# EAGLE schematic Resistor_Resistor (EAGLE 8.3.0), part 43 of 43
## Nets (continued)
N$199: R37801.2 R37802.2 R37803.2 R37804.2 R37805.2 R37806.2 R37807.2 R37808.2 R37809.2 R37810.2 R37811.2 R37812.2 R37813.2 R37814.2 R37815.2 R37816.2 R37817.2 R37818.2 R37819.2 R37820.2 R37821.2 R37822.2 R37823.2 R37824.2 R37825.2 R37826.2 R37827.2 R37828.2 R37829.2 R37830.2 R37831.2 R37832.2 R37833.2 R37834.2 R37835.2 R37836.2 R37837.2 R37838.2 R37839.2 R37840.2 R37841.2 R37842.2 R37843.2 R37844.2 R37845.2 R37846.2 R37847.2 R37848.2 R37849.2 R37850.2 R37851.2 R37852.2 R37853.2 R37854.2 R37855.2 R37856.2 R37857.2 R37858.2 R37859.2 R37860.2 R37861.2 R37862.2 R37863.2 R37864.2 R37865.2 R37866.2 R37867.2 R37868.2 R37869.2 R37870.2 R37871.2 R37872.2 R37873.2 R37874.2 R37875.2 R37876.2 R37877.2 R37878.2 R37879.2 R37880.2 R37881.2 R37882.2 R37883.2 R37884.2 R37885.2 R37886.2 R37887.2 R37888.2 R37889.2 R37890.2 R37891.2 R37892.2 R37893.2 R37894.2 R37895.2 R37896.2 R37897.2 R37898.2 R37899.2 R37900.2 R37901.2 R37902.2 R37903.2 R37904.2 R37905.2 R37906.2 R37907.2 R37908.2 R37909.2 R37910.2 R37911.2 R37912.2 R37913.2 R37914.2 R37915.2 R37916.2 R37917.2 R37918.2 R37919.2 R37920.2 R37921.2 R37922.2 R37923.2 R37924.2 R37925.2 R37926.2 R37927.2 R37928.2 R37929.2 R37930.2 R37931.2 R37932.2 R37933.2 R37934.2 R37935.2 R37936.2 R37937.2 R37938.2 R37939.2 R37940.2 R37941.2 R37942.2 R37943.2 R37944.2 R37945.2 R37946.2 R37947.2 R37948.2 R37949.2 R37950.2 R37951.2 R37952.2 R37953.2 R37954.2 R37955.2 R37956.2 R37957.2 R37958.2 R37959.2 R37960.2 R37961.2 R37962.2 R37963.2 R37964.2 R37965.2 R37966.2 R37967.2 R37968.2 R37969.2 R37970.2 R37971.2 R37972.2 R37973.2 R37974.2 R37975.2 R37976.2 R37977.2 R37978.2 R37979.2 R37980.2 R37981.2 R37982.2 R37983.2 R37984.2 R37985.2 R37986.2 R37987.2 R37988.2 R37989.2 R37990.2 R37991.2 R37992.2 R37993.2 R37994.2 R37995.2 R37996.2 R37997.2 R37998.2 R37999.2 R38000.2 R38001.1 R38002.1 R38003.1 R38004.1 R38005.1 R38006.1 R38007.1 R38008.1 R38009.1 R38010.1 R38011.1 R38012.1 R38013.1 R38014.1 R38015.1 R38016.1 R38017.1 R38018.1 R38019.1 R38020.1 R38021.1 R38022.1 R38023.1 R38024.1 R38025.1 R38026.1 R38027.1 R38028.1 R38029.1 R38030.1 R38031.1 R38032.1 R38033.1 R38034.1 R38035.1 R38036.1 R38037.1 R38038.1 R38039.1 R38040.1 R38041.1 R38042.1 R38043.1 R38044.1 R38045.1 R38046.1 R38047.1 R38048.1 R38049.1 R38050.1 R38051.1 R38052.1 R38053.1 R38054.1 R38055.1 R38056.1 R38057.1 R38058.1 R38059.1 R38060.1 R38061.1 R38062.1 R38063.1 R38064.1 R38065.1 R38066.1 R38067.1 R38068.1 R38069.1 R38070.1 R38071.1 R38072.1 R38073.1 R38074.1 R38075.1 R38076.1 R38077.1 R38078.1 R38079.1 R38080.1 R38081.1 R38082.1 R38083.1 R38084.1 R38085.1 R38086.1 R38087.1 R38088.1 R38089.1 R38090.1 R38091.1 R38092.1 R38093.1 R38094.1 R38095.1 R38096.1 R38097.1 R38098.1 R38099.1 R38100.1 R38101.1 R38102.1 R38103.1 R38104.1 R38105.1 R38106.1 R38107.1 R38108.1 R38109.1 R38110.1 R38111.1 R38112.1 R38113.1 R38114.1 R38115.1 R38116.1 R38117.1 R38118.1 R38119.1 R38120.1 R38121.1 R38122.1 R38123.1 R38124.1 R38125.1 R38126.1 R38127.1 R38128.1 R38129.1 R38130.1 R38131.1 R38132.1 R38133.1 R38134.1 R38135.1 R38136.1 R38137.1 R38138.1 R38139.1 R38140.1 R38141.1 R38142.1 R38143.1 R38144.1 R38145.1 R38146.1 R38147.1 R38148.1 R38149.1 R38150.1 R38151.1 R38152.1 R38153.1 R38154.1 R38155.1 R38156.1 R38157.1 R38158.1 R38159.1 R38160.1 R38161.1 R38162.1 R38163.1 R38164.1 R38165.1 R38166.1 R38167.1 R38168.1 R38169.1 R38170.1 R38171.1 R38172.1 R38173.1 R38174.1 R38175.1 R38176.1 R38177.1 R38178.1 R38179.1 R38180.1 R38181.1 R38182.1 R38183.1 R38184.1 R38185.1 R38186.1 R38187.1 R38188.1 R38189.1 R38190.1 R38191.1 R38192.1 R38193.1 R38194.1 R38195.1 R38196.1 R38197.1 R38198.1 R38199.1 R38200.1
N$200: R38001.2 R38002.2 R38003.2 R38004.2 R38005.2 R38006.2 R38007.2 R38008.2 R38009.2 R38010.2 R38011.2 R38012.2 R38013.2 R38014.2 R38015.2 R38016.2 R38017.2 R38018.2 R38019.2 R38020.2 R38021.2 R38022.2 R38023.2 R38024.2 R38025.2 R38026.2 R38027.2 R38028.2 R38029.2 R38030.2 R38031.2 R38032.2 R38033.2 R38034.2 R38035.2 R38036.2 R38037.2 R38038.2 R38039.2 R38040.2 R38041.2 R38042.2 R38043.2 R38044.2 R38045.2 R38046.2 R38047.2 R38048.2 R38049.2 R38050.2 R38051.2 R38052.2 R38053.2 R38054.2 R38055.2 R38056.2 R38057.2 R38058.2 R38059.2 R38060.2 R38061.2 R38062.2 R38063.2 R38064.2 R38065.2 R38066.2 R38067.2 R38068.2 R38069.2 R38070.2 R38071.2 R38072.2 R38073.2 R38074.2 R38075.2 R38076.2 R38077.2 R38078.2 R38079.2 R38080.2 R38081.2 R38082.2 R38083.2 R38084.2 R38085.2 R38086.2 R38087.2 R38088.2 R38089.2 R38090.2 R38091.2 R38092.2 R38093.2 R38094.2 R38095.2 R38096.2 R38097.2 R38098.2 R38099.2 R38100.2 R38101.2 R38102.2 R38103.2 R38104.2 R38105.2 R38106.2 R38107.2 R38108.2 R38109.2 R38110.2 R38111.2 R38112.2 R38113.2 R38114.2 R38115.2 R38116.2 R38117.2 R38118.2 R38119.2 R38120.2 R38121.2 R38122.2 R38123.2 R38124.2 R38125.2 R38126.2 R38127.2 R38128.2 R38129.2 R38130.2 R38131.2 R38132.2 R38133.2 R38134.2 R38135.2 R38136.2 R38137.2 R38138.2 R38139.2 R38140.2 R38141.2 R38142.2 R38143.2 R38144.2 R38145.2 R38146.2 R38147.2 R38148.2 R38149.2 R38150.2 R38151.2 R38152.2 R38153.2 R38154.2 R38155.2 R38156.2 R38157.2 R38158.2 R38159.2 R38160.2 R38161.2 R38162.2 R38163.2 R38164.2 R38165.2 R38166.2 R38167.2 R38168.2 R38169.2 R38170.2 R38171.2 R38172.2 R38173.2 R38174.2 R38175.2 R38176.2 R38177.2 R38178.2 R38179.2 R38180.2 R38181.2 R38182.2 R38183.2 R38184.2 R38185.2 R38186.2 R38187.2 R38188.2 R38189.2 R38190.2 R38191.2 R38192.2 R38193.2 R38194.2 R38195.2 R38196.2 R38197.2 R38198.2 R38199.2 R38200.2 R38201.1 R38202.1 R38203.1 R38204.1 R38205.1 R38206.1 R38207.1 R38208.1 R38209.1 R38210.1 R38211.1 R38212.1 R38213.1 R38214.1 R38215.1 R38216.1 R38217.1 R38218.1 R38219.1 R38220.1 R38221.1 R38222.1 R38223.1 R38224.1 R38225.1 R38226.1 R38227.1 R38228.1 R38229.1 R38230.1 R38231.1 R38232.1 R38233.1 R38234.1 R38235.1 R38236.1 R38237.1 R38238.1 R38239.1 R38240.1 R38241.1 R38242.1 R38243.1 R38244.1 R38245.1 R38246.1 R38247.1 R38248.1 R38249.1 R38250.1 R38251.1 R38252.1 R38253.1 R38254.1 R38255.1 R38256.1 R38257.1 R38258.1 R38259.1 R38260.1 R38261.1 R38262.1 R38263.1 R38264.1 R38265.1 R38266.1 R38267.1 R38268.1 R38269.1 R38270.1 R38271.1 R38272.1 R38273.1 R38274.1 R38275.1 R38276.1 R38277.1 R38278.1 R38279.1 R38280.1 R38281.1 R38282.1 R38283.1 R38284.1 R38285.1 R38286.1 R38287.1 R38288.1 R38289.1 R38290.1 R38291.1 R38292.1 R38293.1 R38294.1 R38295.1 R38296.1 R38297.1 R38298.1 R38299.1 R38300.1 R38301.1 R38302.1 R38303.1 R38304.1 R38305.1 R38306.1 R38307.1 R38308.1 R38309.1 R38310.1 R38311.1 R38312.1 R38313.1 R38314.1 R38315.1 R38316.1 R38317.1 R38318.1 R38319.1 R38320.1 R38321.1 R38322.1 R38323.1 R38324.1 R38325.1 R38326.1 R38327.1 R38328.1 R38329.1 R38330.1 R38331.1 R38332.1 R38333.1 R38334.1 R38335.1 R38336.1 R38337.1 R38338.1 R38339.1 R38340.1 R38341.1 R38342.1 R38343.1 R38344.1 R38345.1 R38346.1 R38347.1 R38348.1 R38349.1 R38350.1 R38351.1 R38352.1 R38353.1 R38354.1 R38355.1 R38356.1 R38357.1 R38358.1 R38359.1 R38360.1 R38361.1 R38362.1 R38363.1 R38364.1 R38365.1 R38366.1 R38367.1 R38368.1 R38369.1 R38370.1 R38371.1 R38372.1 R38373.1 R38374.1 R38375.1 R38376.1 R38377.1 R38378.1 R38379.1 R38380.1 R38381.1 R38382.1 R38383.1 R38384.1 R38385.1 R38386.1 R38387.1 R38388.1 R38389.1 R38390.1 R38391.1 R38392.1 R38393.1 R38394.1 R38395.1 R38396.1 R38397.1 R38398.1 R38399.1 R38400.1
N$201: R38201.2 R38202.2 R38203.2 R38204.2 R38205.2 R38206.2 R38207.2 R38208.2 R38209.2 R38210.2 R38211.2 R38212.2 R38213.2 R38214.2 R38215.2 R38216.2 R38217.2 R38218.2 R38219.2 R38220.2 R38221.2 R38222.2 R38223.2 R38224.2 R38225.2 R38226.2 R38227.2 R38228.2 R38229.2 R38230.2 R38231.2 R38232.2 R38233.2 R38234.2 R38235.2 R38236.2 R38237.2 R38238.2 R38239.2 R38240.2 R38241.2 R38242.2 R38243.2 R38244.2 R38245.2 R38246.2 R38247.2 R38248.2 R38249.2 R38250.2 R38251.2 R38252.2 R38253.2 R38254.2 R38255.2 R38256.2 R38257.2 R38258.2 R38259.2 R38260.2 R38261.2 R38262.2 R38263.2 R38264.2 R38265.2 R38266.2 R38267.2 R38268.2 R38269.2 R38270.2 R38271.2 R38272.2 R38273.2 R38274.2 R38275.2 R38276.2 R38277.2 R38278.2 R38279.2 R38280.2 R38281.2 R38282.2 R38283.2 R38284.2 R38285.2 R38286.2 R38287.2 R38288.2 R38289.2 R38290.2 R38291.2 R38292.2 R38293.2 R38294.2 R38295.2 R38296.2 R38297.2 R38298.2 R38299.2 R38300.2 R38301.2 R38302.2 R38303.2 R38304.2 R38305.2 R38306.2 R38307.2 R38308.2 R38309.2 R38310.2 R38311.2 R38312.2 R38313.2 R38314.2 R38315.2 R38316.2 R38317.2 R38318.2 R38319.2 R38320.2 R38321.2 R38322.2 R38323.2 R38324.2 R38325.2 R38326.2 R38327.2 R38328.2 R38329.2 R38330.2 R38331.2 R38332.2 R38333.2 R38334.2 R38335.2 R38336.2 R38337.2 R38338.2 R38339.2 R38340.2 R38341.2 R38342.2 R38343.2 R38344.2 R38345.2 R38346.2 R38347.2 R38348.2 R38349.2 R38350.2 R38351.2 R38352.2 R38353.2 R38354.2 R38355.2 R38356.2 R38357.2 R38358.2 R38359.2 R38360.2 R38361.2 R38362.2 R38363.2 R38364.2 R38365.2 R38366.2 R38367.2 R38368.2 R38369.2 R38370.2 R38371.2 R38372.2 R38373.2 R38374.2 R38375.2 R38376.2 R38377.2 R38378.2 R38379.2 R38380.2 R38381.2 R38382.2 R38383.2 R38384.2 R38385.2 R38386.2 R38387.2 R38388.2 R38389.2 R38390.2 R38391.2 R38392.2 R38393.2 R38394.2 R38395.2 R38396.2 R38397.2 R38398.2 R38399.2 R38400.2 R38401.1 R38402.1 R38403.1 R38404.1 R38405.1 R38406.1 R38407.1 R38408.1 R38409.1 R38410.1 R38411.1 R38412.1 R38413.1 R38414.1 R38415.1 R38416.1 R38417.1 R38418.1 R38419.1 R38420.1 R38421.1 R38422.1 R38423.1 R38424.1 R38425.1 R38426.1 R38427.1 R38428.1 R38429.1 R38430.1 R38431.1 R38432.1 R38433.1 R38434.1 R38435.1 R38436.1 R38437.1 R38438.1 R38439.1 R38440.1 R38441.1 R38442.1 R38443.1 R38444.1 R38445.1 R38446.1 R38447.1 R38448.1 R38449.1 R38450.1 R38451.1 R38452.1 R38453.1 R38454.1 R38455.1 R38456.1 R38457.1 R38458.1 R38459.1 R38460.1 R38461.1 R38462.1 R38463.1 R38464.1 R38465.1 R38466.1 R38467.1 R38468.1 R38469.1 R38470.1 R38471.1 R38472.1 R38473.1 R38474.1 R38475.1 R38476.1 R38477.1 R38478.1 R38479.1 R38480.1 R38481.1 R38482.1 R38483.1 R38484.1 R38485.1 R38486.1 R38487.1 R38488.1 R38489.1 R38490.1 R38491.1 R38492.1 R38493.1 R38494.1 R38495.1 R38496.1 R38497.1 R38498.1 R38499.1 R38500.1 R38501.1 R38502.1 R38503.1 R38504.1 R38505.1 R38506.1 R38507.1 R38508.1 R38509.1 R38510.1 R38511.1 R38512.1 R38513.1 R38514.1 R38515.1 R38516.1 R38517.1 R38518.1 R38519.1 R38520.1 R38521.1 R38522.1 R38523.1 R38524.1 R38525.1 R38526.1 R38527.1 R38528.1 R38529.1 R38530.1 R38531.1 R38532.1 R38533.1 R38534.1 R38535.1 R38536.1 R38537.1 R38538.1 R38539.1 R38540.1 R38541.1 R38542.1 R38543.1 R38544.1 R38545.1 R38546.1 R38547.1 R38548.1 R38549.1 R38550.1 R38551.1 R38552.1 R38553.1 R38554.1 R38555.1 R38556.1 R38557.1 R38558.1 R38559.1 R38560.1 R38561.1 R38562.1 R38563.1 R38564.1 R38565.1 R38566.1 R38567.1 R38568.1 R38569.1 R38570.1 R38571.1 R38572.1 R38573.1 R38574.1 R38575.1 R38576.1 R38577.1 R38578.1 R38579.1 R38580.1 R38581.1 R38582.1 R38583.1 R38584.1 R38585.1 R38586.1 R38587.1 R38588.1 R38589.1 R38590.1 R38591.1 R38592.1 R38593.1 R38594.1 R38595.1 R38596.1 R38597.1 R38598.1 R38599.1 R38600.1
N$202: R38401.2 R38402.2 R38403.2 R38404.2 R38405.2 R38406.2 R38407.2 R38408.2 R38409.2 R38410.2 R38411.2 R38412.2 R38413.2 R38414.2 R38415.2 R38416.2 R38417.2 R38418.2 R38419.2 R38420.2 R38421.2 R38422.2 R38423.2 R38424.2 R38425.2 R38426.2 R38427.2 R38428.2 R38429.2 R38430.2 R38431.2 R38432.2 R38433.2 R38434.2 R38435.2 R38436.2 R38437.2 R38438.2 R38439.2 R38440.2 R38441.2 R38442.2 R38443.2 R38444.2 R38445.2 R38446.2 R38447.2 R38448.2 R38449.2 R38450.2 R38451.2 R38452.2 R38453.2 R38454.2 R38455.2 R38456.2 R38457.2 R38458.2 R38459.2 R38460.2 R38461.2 R38462.2 R38463.2 R38464.2 R38465.2 R38466.2 R38467.2 R38468.2 R38469.2 R38470.2 R38471.2 R38472.2 R38473.2 R38474.2 R38475.2 R38476.2 R38477.2 R38478.2 R38479.2 R38480.2 R38481.2 R38482.2 R38483.2 R38484.2 R38485.2 R38486.2 R38487.2 R38488.2 R38489.2 R38490.2 R38491.2 R38492.2 R38493.2 R38494.2 R38495.2 R38496.2 R38497.2 R38498.2 R38499.2 R38500.2 R38501.2 R38502.2 R38503.2 R38504.2 R38505.2 R38506.2 R38507.2 R38508.2 R38509.2 R38510.2 R38511.2 R38512.2 R38513.2 R38514.2 R38515.2 R38516.2 R38517.2 R38518.2 R38519.2 R38520.2 R38521.2 R38522.2 R38523.2 R38524.2 R38525.2 R38526.2 R38527.2 R38528.2 R38529.2 R38530.2 R38531.2 R38532.2 R38533.2 R38534.2 R38535.2 R38536.2 R38537.2 R38538.2 R38539.2 R38540.2 R38541.2 R38542.2 R38543.2 R38544.2 R38545.2 R38546.2 R38547.2 R38548.2 R38549.2 R38550.2 R38551.2 R38552.2 R38553.2 R38554.2 R38555.2 R38556.2 R38557.2 R38558.2 R38559.2 R38560.2 R38561.2 R38562.2 R38563.2 R38564.2 R38565.2 R38566.2 R38567.2 R38568.2 R38569.2 R38570.2 R38571.2 R38572.2 R38573.2 R38574.2 R38575.2 R38576.2 R38577.2 R38578.2 R38579.2 R38580.2 R38581.2 R38582.2 R38583.2 R38584.2 R38585.2 R38586.2 R38587.2 R38588.2 R38589.2 R38590.2 R38591.2 R38592.2 R38593.2 R38594.2 R38595.2 R38596.2 R38597.2 R38598.2 R38599.2 R38600.2 R38601.1 R38602.1 R38603.1 R38604.1 R38605.1 R38606.1 R38607.1 R38608.1 R38609.1 R38610.1 R38611.1 R38612.1 R38613.1 R38614.1 R38615.1 R38616.1 R38617.1 R38618.1 R38619.1 R38620.1 R38621.1 R38622.1 R38623.1 R38624.1 R38625.1 R38626.1 R38627.1 R38628.1 R38629.1 R38630.1 R38631.1 R38632.1 R38633.1 R38634.1 R38635.1 R38636.1 R38637.1 R38638.1 R38639.1 R38640.1 R38641.1 R38642.1 R38643.1 R38644.1 R38645.1 R38646.1 R38647.1 R38648.1 R38649.1 R38650.1 R38651.1 R38652.1 R38653.1 R38654.1 R38655.1 R38656.1 R38657.1 R38658.1 R38659.1 R38660.1 R38661.1 R38662.1 R38663.1 R38664.1 R38665.1 R38666.1 R38667.1 R38668.1 R38669.1 R38670.1 R38671.1 R38672.1 R38673.1 R38674.1 R38675.1 R38676.1 R38677.1 R38678.1 R38679.1 R38680.1 R38681.1 R38682.1 R38683.1 R38684.1 R38685.1 R38686.1 R38687.1 R38688.1 R38689.1 R38690.1 R38691.1 R38692.1 R38693.1 R38694.1 R38695.1 R38696.1 R38697.1 R38698.1 R38699.1 R38700.1 R38701.1 R38702.1 R38703.1 R38704.1 R38705.1 R38706.1 R38707.1 R38708.1 R38709.1 R38710.1 R38711.1 R38712.1 R38713.1 R38714.1 R38715.1 R38716.1 R38717.1 R38718.1 R38719.1 R38720.1 R38721.1 R38722.1 R38723.1 R38724.1 R38725.1 R38726.1 R38727.1 R38728.1 R38729.1 R38730.1 R38731.1 R38732.1 R38733.1 R38734.1 R38735.1 R38736.1 R38737.1 R38738.1 R38739.1 R38740.1 R38741.1 R38742.1 R38743.1 R38744.1 R38745.1 R38746.1 R38747.1 R38748.1 R38749.1 R38750.1 R38751.1 R38752.1 R38753.1 R38754.1 R38755.1 R38756.1 R38757.1 R38758.1 R38759.1 R38760.1 R38761.1 R38762.1 R38763.1 R38764.1 R38765.1 R38766.1 R38767.1 R38768.1 R38769.1 R38770.1 R38771.1 R38772.1 R38773.1 R38774.1 R38775.1 R38776.1 R38777.1 R38778.1 R38779.1 R38780.1 R38781.1 R38782.1 R38783.1 R38784.1 R38785.1 R38786.1 R38787.1 R38788.1 R38789.1 R38790.1 R38791.1 R38792.1 R38793.1 R38794.1 R38795.1 R38796.1 R38797.1 R38798.1 R38799.1 R38800.1
N$203: R38601.2 R38602.2 R38603.2 R38604.2 R38605.2 R38606.2 R38607.2 R38608.2 R38609.2 R38610.2 R38611.2 R38612.2 R38613.2 R38614.2 R38615.2 R38616.2 R38617.2 R38618.2 R38619.2 R38620.2 R38621.2 R38622.2 R38623.2 R38624.2 R38625.2 R38626.2 R38627.2 R38628.2 R38629.2 R38630.2 R38631.2 R38632.2 R38633.2 R38634.2 R38635.2 R38636.2 R38637.2 R38638.2 R38639.2 R38640.2 R38641.2 R38642.2 R38643.2 R38644.2 R38645.2 R38646.2 R38647.2 R38648.2 R38649.2 R38650.2 R38651.2 R38652.2 R38653.2 R38654.2 R38655.2 R38656.2 R38657.2 R38658.2 R38659.2 R38660.2 R38661.2 R38662.2 R38663.2 R38664.2 R38665.2 R38666.2 R38667.2 R38668.2 R38669.2 R38670.2 R38671.2 R38672.2 R38673.2 R38674.2 R38675.2 R38676.2 R38677.2 R38678.2 R38679.2 R38680.2 R38681.2 R38682.2 R38683.2 R38684.2 R38685.2 R38686.2 R38687.2 R38688.2 R38689.2 R38690.2 R38691.2 R38692.2 R38693.2 R38694.2 R38695.2 R38696.2 R38697.2 R38698.2 R38699.2 R38700.2 R38701.2 R38702.2 R38703.2 R38704.2 R38705.2 R38706.2 R38707.2 R38708.2 R38709.2 R38710.2 R38711.2 R38712.2 R38713.2 R38714.2 R38715.2 R38716.2 R38717.2 R38718.2 R38719.2 R38720.2 R38721.2 R38722.2 R38723.2 R38724.2 R38725.2 R38726.2 R38727.2 R38728.2 R38729.2 R38730.2 R38731.2 R38732.2 R38733.2 R38734.2 R38735.2 R38736.2 R38737.2 R38738.2 R38739.2 R38740.2 R38741.2 R38742.2 R38743.2 R38744.2 R38745.2 R38746.2 R38747.2 R38748.2 R38749.2 R38750.2 R38751.2 R38752.2 R38753.2 R38754.2 R38755.2 R38756.2 R38757.2 R38758.2 R38759.2 R38760.2 R38761.2 R38762.2 R38763.2 R38764.2 R38765.2 R38766.2 R38767.2 R38768.2 R38769.2 R38770.2 R38771.2 R38772.2 R38773.2 R38774.2 R38775.2 R38776.2 R38777.2 R38778.2 R38779.2 R38780.2 R38781.2 R38782.2 R38783.2 R38784.2 R38785.2 R38786.2 R38787.2 R38788.2 R38789.2 R38790.2 R38791.2 R38792.2 R38793.2 R38794.2 R38795.2 R38796.2 R38797.2 R38798.2 R38799.2 R38800.2 R38801.1 R38802.1 R38803.1 R38804.1 R38805.1 R38806.1 R38807.1 R38808.1 R38809.1 R38810.1 R38811.1 R38812.1 R38813.1 R38814.1 R38815.1 R38816.1 R38817.1 R38818.1 R38819.1 R38820.1 R38821.1 R38822.1 R38823.1 R38824.1 R38825.1 R38826.1 R38827.1 R38828.1 R38829.1 R38830.1 R38831.1 R38832.1 R38833.1 R38834.1 R38835.1 R38836.1 R38837.1 R38838.1 R38839.1 R38840.1 R38841.1 R38842.1 R38843.1 R38844.1 R38845.1 R38846.1 R38847.1 R38848.1 R38849.1 R38850.1 R38851.1 R38852.1 R38853.1 R38854.1 R38855.1 R38856.1 R38857.1 R38858.1 R38859.1 R38860.1 R38861.1 R38862.1 R38863.1 R38864.1 R38865.1 R38866.1 R38867.1 R38868.1 R38869.1 R38870.1 R38871.1 R38872.1 R38873.1 R38874.1 R38875.1 R38876.1 R38877.1 R38878.1 R38879.1 R38880.1 R38881.1 R38882.1 R38883.1 R38884.1 R38885.1 R38886.1 R38887.1 R38888.1 R38889.1 R38890.1 R38891.1 R38892.1 R38893.1 R38894.1 R38895.1 R38896.1 R38897.1 R38898.1 R38899.1 R38900.1 R38901.1 R38902.1 R38903.1 R38904.1 R38905.1 R38906.1 R38907.1 R38908.1 R38909.1 R38910.1 R38911.1 R38912.1 R38913.1 R38914.1 R38915.1 R38916.1 R38917.1 R38918.1 R38919.1 R38920.1 R38921.1 R38922.1 R38923.1 R38924.1 R38925.1 R38926.1 R38927.1 R38928.1 R38929.1 R38930.1 R38931.1 R38932.1 R38933.1 R38934.1 R38935.1 R38936.1 R38937.1 R38938.1 R38939.1 R38940.1 R38941.1 R38942.1 R38943.1 R38944.1 R38945.1 R38946.1 R38947.1 R38948.1 R38949.1 R38950.1 R38951.1 R38952.1 R38953.1 R38954.1 R38955.1 R38956.1 R38957.1 R38958.1 R38959.1 R38960.1 R38961.1 R38962.1 R38963.1 R38964.1 R38965.1 R38966.1 R38967.1 R38968.1 R38969.1 R38970.1 R38971.1 R38972.1 R38973.1 R38974.1 R38975.1 R38976.1 R38977.1 R38978.1 R38979.1 R38980.1 R38981.1 R38982.1 R38983.1 R38984.1 R38985.1 R38986.1 R38987.1 R38988.1 R38989.1 R38990.1 R38991.1 R38992.1 R38993.1 R38994.1 R38995.1 R38996.1 R38997.1 R38998.1 R38999.1 R39000.1
N$204: R38801.2 R38802.2 R38803.2 R38804.2 R38805.2 R38806.2 R38807.2 R38808.2 R38809.2 R38810.2 R38811.2 R38812.2 R38813.2 R38814.2 R38815.2 R38816.2 R38817.2 R38818.2 R38819.2 R38820.2 R38821.2 R38822.2 R38823.2 R38824.2 R38825.2 R38826.2 R38827.2 R38828.2 R38829.2 R38830.2 R38831.2 R38832.2 R38833.2 R38834.2 R38835.2 R38836.2 R38837.2 R38838.2 R38839.2 R38840.2 R38841.2 R38842.2 R38843.2 R38844.2 R38845.2 R38846.2 R38847.2 R38848.2 R38849.2 R38850.2 R38851.2 R38852.2 R38853.2 R38854.2 R38855.2 R38856.2 R38857.2 R38858.2 R38859.2 R38860.2 R38861.2 R38862.2 R38863.2 R38864.2 R38865.2 R38866.2 R38867.2 R38868.2 R38869.2 R38870.2 R38871.2 R38872.2 R38873.2 R38874.2 R38875.2 R38876.2 R38877.2 R38878.2 R38879.2 R38880.2 R38881.2 R38882.2 R38883.2 R38884.2 R38885.2 R38886.2 R38887.2 R38888.2 R38889.2 R38890.2 R38891.2 R38892.2 R38893.2 R38894.2 R38895.2 R38896.2 R38897.2 R38898.2 R38899.2 R38900.2 R38901.2 R38902.2 R38903.2 R38904.2 R38905.2 R38906.2 R38907.2 R38908.2 R38909.2 R38910.2 R38911.2 R38912.2 R38913.2 R38914.2 R38915.2 R38916.2 R38917.2 R38918.2 R38919.2 R38920.2 R38921.2 R38922.2 R38923.2 R38924.2 R38925.2 R38926.2 R38927.2 R38928.2 R38929.2 R38930.2 R38931.2 R38932.2 R38933.2 R38934.2 R38935.2 R38936.2 R38937.2 R38938.2 R38939.2 R38940.2 R38941.2 R38942.2 R38943.2 R38944.2 R38945.2 R38946.2 R38947.2 R38948.2 R38949.2 R38950.2 R38951.2 R38952.2 R38953.2 R38954.2 R38955.2 R38956.2 R38957.2 R38958.2 R38959.2 R38960.2 R38961.2 R38962.2 R38963.2 R38964.2 R38965.2 R38966.2 R38967.2 R38968.2 R38969.2 R38970.2 R38971.2 R38972.2 R38973.2 R38974.2 R38975.2 R38976.2 R38977.2 R38978.2 R38979.2 R38980.2 R38981.2 R38982.2 R38983.2 R38984.2 R38985.2 R38986.2 R38987.2 R38988.2 R38989.2 R38990.2 R38991.2 R38992.2 R38993.2 R38994.2 R38995.2 R38996.2 R38997.2 R38998.2 R38999.2 R39000.2 R39001.1 R39002.1 R39003.1 R39004.1 R39005.1 R39006.1 R39007.1 R39008.1 R39009.1 R39010.1 R39011.1 R39012.1 R39013.1 R39014.1 R39015.1 R39016.1 R39017.1 R39018.1 R39019.1 R39020.1 R39021.1 R39022.1 R39023.1 R39024.1 R39025.1 R39026.1 R39027.1 R39028.1 R39029.1 R39030.1 R39031.1 R39032.1 R39033.1 R39034.1 R39035.1 R39036.1 R39037.1 R39038.1 R39039.1 R39040.1 R39041.1 R39042.1 R39043.1 R39044.1 R39045.1 R39046.1 R39047.1 R39048.1 R39049.1 R39050.1 R39051.1 R39052.1 R39053.1 R39054.1 R39055.1 R39056.1 R39057.1 R39058.1 R39059.1 R39060.1 R39061.1 R39062.1 R39063.1 R39064.1 R39065.1 R39066.1 R39067.1 R39068.1 R39069.1 R39070.1 R39071.1 R39072.1 R39073.1 R39074.1 R39075.1 R39076.1 R39077.1 R39078.1 R39079.1 R39080.1 R39081.1 R39082.1 R39083.1 R39084.1 R39085.1 R39086.1 R39087.1 R39088.1 R39089.1 R39090.1 R39091.1 R39092.1 R39093.1 R39094.1 R39095.1 R39096.1 R39097.1 R39098.1 R39099.1 R39100.1 R39101.1 R39102.1 R39103.1 R39104.1 R39105.1 R39106.1 R39107.1 R39108.1 R39109.1 R39110.1 R39111.1 R39112.1 R39113.1 R39114.1 R39115.1 R39116.1 R39117.1 R39118.1 R39119.1 R39120.1 R39121.1 R39122.1 R39123.1 R39124.1 R39125.1 R39126.1 R39127.1 R39128.1 R39129.1 R39130.1 R39131.1 R39132.1 R39133.1 R39134.1 R39135.1 R39136.1 R39137.1 R39138.1 R39139.1 R39140.1 R39141.1 R39142.1 R39143.1 R39144.1 R39145.1 R39146.1 R39147.1 R39148.1 R39149.1 R39150.1 R39151.1 R39152.1 R39153.1 R39154.1 R39155.1 R39156.1 R39157.1 R39158.1 R39159.1 R39160.1 R39161.1 R39162.1 R39163.1 R39164.1 R39165.1 R39166.1 R39167.1 R39168.1 R39169.1 R39170.1 R39171.1 R39172.1 R39173.1 R39174.1 R39175.1 R39176.1 R39177.1 R39178.1 R39179.1 R39180.1 R39181.1 R39182.1 R39183.1 R39184.1 R39185.1 R39186.1 R39187.1 R39188.1 R39189.1 R39190.1 R39191.1 R39192.1 R39193.1 R39194.1 R39195.1 R39196.1 R39197.1 R39198.1 R39199.1 R39200.1
N$205: R39001.2 R39002.2 R39003.2 R39004.2 R39005.2 R39006.2 R39007.2 R39008.2 R39009.2 R39010.2 R39011.2 R39012.2 R39013.2 R39014.2 R39015.2 R39016.2 R39017.2 R39018.2 R39019.2 R39020.2 R39021.2 R39022.2 R39023.2 R39024.2 R39025.2 R39026.2 R39027.2 R39028.2 R39029.2 R39030.2 R39031.2 R39032.2 R39033.2 R39034.2 R39035.2 R39036.2 R39037.2 R39038.2 R39039.2 R39040.2 R39041.2 R39042.2 R39043.2 R39044.2 R39045.2 R39046.2 R39047.2 R39048.2 R39049.2 R39050.2 R39051.2 R39052.2 R39053.2 R39054.2 R39055.2 R39056.2 R39057.2 R39058.2 R39059.2 R39060.2 R39061.2 R39062.2 R39063.2 R39064.2 R39065.2 R39066.2 R39067.2 R39068.2 R39069.2 R39070.2 R39071.2 R39072.2 R39073.2 R39074.2 R39075.2 R39076.2 R39077.2 R39078.2 R39079.2 R39080.2 R39081.2 R39082.2 R39083.2 R39084.2 R39085.2 R39086.2 R39087.2 R39088.2 R39089.2 R39090.2 R39091.2 R39092.2 R39093.2 R39094.2 R39095.2 R39096.2 R39097.2 R39098.2 R39099.2 R39100.2 R39101.2 R39102.2 R39103.2 R39104.2 R39105.2 R39106.2 R39107.2 R39108.2 R39109.2 R39110.2 R39111.2 R39112.2 R39113.2 R39114.2 R39115.2 R39116.2 R39117.2 R39118.2 R39119.2 R39120.2 R39121.2 R39122.2 R39123.2 R39124.2 R39125.2 R39126.2 R39127.2 R39128.2 R39129.2 R39130.2 R39131.2 R39132.2 R39133.2 R39134.2 R39135.2 R39136.2 R39137.2 R39138.2 R39139.2 R39140.2 R39141.2 R39142.2 R39143.2 R39144.2 R39145.2 R39146.2 R39147.2 R39148.2 R39149.2 R39150.2 R39151.2 R39152.2 R39153.2 R39154.2 R39155.2 R39156.2 R39157.2 R39158.2 R39159.2 R39160.2 R39161.2 R39162.2 R39163.2 R39164.2 R39165.2 R39166.2 R39167.2 R39168.2 R39169.2 R39170.2 R39171.2 R39172.2 R39173.2 R39174.2 R39175.2 R39176.2 R39177.2 R39178.2 R39179.2 R39180.2 R39181.2 R39182.2 R39183.2 R39184.2 R39185.2 R39186.2 R39187.2 R39188.2 R39189.2 R39190.2 R39191.2 R39192.2 R39193.2 R39194.2 R39195.2 R39196.2 R39197.2 R39198.2 R39199.2 R39200.2 R39201.1 R39202.1 R39203.1 R39204.1 R39205.1 R39206.1 R39207.1 R39208.1 R39209.1 R39210.1 R39211.1 R39212.1 R39213.1 R39214.1 R39215.1 R39216.1 R39217.1 R39218.1 R39219.1 R39220.1 R39221.1 R39222.1 R39223.1 R39224.1 R39225.1 R39226.1 R39227.1 R39228.1 R39229.1 R39230.1 R39231.1 R39232.1 R39233.1 R39234.1 R39235.1 R39236.1 R39237.1 R39238.1 R39239.1 R39240.1 R39241.1 R39242.1 R39243.1 R39244.1 R39245.1 R39246.1 R39247.1 R39248.1 R39249.1 R39250.1 R39251.1 R39252.1 R39253.1 R39254.1 R39255.1 R39256.1 R39257.1 R39258.1 R39259.1 R39260.1 R39261.1 R39262.1 R39263.1 R39264.1 R39265.1 R39266.1 R39267.1 R39268.1 R39269.1 R39270.1 R39271.1 R39272.1 R39273.1 R39274.1 R39275.1 R39276.1 R39277.1 R39278.1 R39279.1 R39280.1 R39281.1 R39282.1 R39283.1 R39284.1 R39285.1 R39286.1 R39287.1 R39288.1 R39289.1 R39290.1 R39291.1 R39292.1 R39293.1 R39294.1 R39295.1 R39296.1 R39297.1 R39298.1 R39299.1 R39300.1 R39301.1 R39302.1 R39303.1 R39304.1 R39305.1 R39306.1 R39307.1 R39308.1 R39309.1 R39310.1 R39311.1 R39312.1 R39313.1 R39314.1 R39315.1 R39316.1 R39317.1 R39318.1 R39319.1 R39320.1 R39321.1 R39322.1 R39323.1 R39324.1 R39325.1 R39326.1 R39327.1 R39328.1 R39329.1 R39330.1 R39331.1 R39332.1 R39333.1 R39334.1 R39335.1 R39336.1 R39337.1 R39338.1 R39339.1 R39340.1 R39341.1 R39342.1 R39343.1 R39344.1 R39345.1 R39346.1 R39347.1 R39348.1 R39349.1 R39350.1 R39351.1 R39352.1 R39353.1 R39354.1 R39355.1 R39356.1 R39357.1 R39358.1 R39359.1 R39360.1 R39361.1 R39362.1 R39363.1 R39364.1 R39365.1 R39366.1 R39367.1 R39368.1 R39369.1 R39370.1 R39371.1 R39372.1 R39373.1 R39374.1 R39375.1 R39376.1 R39377.1 R39378.1 R39379.1 R39380.1 R39381.1 R39382.1 R39383.1 R39384.1 R39385.1 R39386.1 R39387.1 R39388.1 R39389.1 R39390.1 R39391.1 R39392.1 R39393.1 R39394.1 R39395.1 R39396.1 R39397.1 R39398.1 R39399.1 R39400.1
N$206: R39201.2 R39202.2 R39203.2 R39204.2 R39205.2 R39206.2 R39207.2 R39208.2 R39209.2 R39210.2 R39211.2 R39212.2 R39213.2 R39214.2 R39215.2 R39216.2 R39217.2 R39218.2 R39219.2 R39220.2 R39221.2 R39222.2 R39223.2 R39224.2 R39225.2 R39226.2 R39227.2 R39228.2 R39229.2 R39230.2 R39231.2 R39232.2 R39233.2 R39234.2 R39235.2 R39236.2 R39237.2 R39238.2 R39239.2 R39240.2 R39241.2 R39242.2 R39243.2 R39244.2 R39245.2 R39246.2 R39247.2 R39248.2 R39249.2 R39250.2 R39251.2 R39252.2 R39253.2 R39254.2 R39255.2 R39256.2 R39257.2 R39258.2 R39259.2 R39260.2 R39261.2 R39262.2 R39263.2 R39264.2 R39265.2 R39266.2 R39267.2 R39268.2 R39269.2 R39270.2 R39271.2 R39272.2 R39273.2 R39274.2 R39275.2 R39276.2 R39277.2 R39278.2 R39279.2 R39280.2 R39281.2 R39282.2 R39283.2 R39284.2 R39285.2 R39286.2 R39287.2 R39288.2 R39289.2 R39290.2 R39291.2 R39292.2 R39293.2 R39294.2 R39295.2 R39296.2 R39297.2 R39298.2 R39299.2 R39300.2 R39301.2 R39302.2 R39303.2 R39304.2 R39305.2 R39306.2 R39307.2 R39308.2 R39309.2 R39310.2 R39311.2 R39312.2 R39313.2 R39314.2 R39315.2 R39316.2 R39317.2 R39318.2 R39319.2 R39320.2 R39321.2 R39322.2 R39323.2 R39324.2 R39325.2 R39326.2 R39327.2 R39328.2 R39329.2 R39330.2 R39331.2 R39332.2 R39333.2 R39334.2 R39335.2 R39336.2 R39337.2 R39338.2 R39339.2 R39340.2 R39341.2 R39342.2 R39343.2 R39344.2 R39345.2 R39346.2 R39347.2 R39348.2 R39349.2 R39350.2 R39351.2 R39352.2 R39353.2 R39354.2 R39355.2 R39356.2 R39357.2 R39358.2 R39359.2 R39360.2 R39361.2 R39362.2 R39363.2 R39364.2 R39365.2 R39366.2 R39367.2 R39368.2 R39369.2 R39370.2 R39371.2 R39372.2 R39373.2 R39374.2 R39375.2 R39376.2 R39377.2 R39378.2 R39379.2 R39380.2 R39381.2 R39382.2 R39383.2 R39384.2 R39385.2 R39386.2 R39387.2 R39388.2 R39389.2 R39390.2 R39391.2 R39392.2 R39393.2 R39394.2 R39395.2 R39396.2 R39397.2 R39398.2 R39399.2 R39400.2 R39401.1 R39402.1 R39403.1 R39404.1 R39405.1 R39406.1 R39407.1 R39408.1 R39409.1 R39410.1 R39411.1 R39412.1 R39413.1 R39414.1 R39415.1 R39416.1 R39417.1 R39418.1 R39419.1 R39420.1 R39421.1 R39422.1 R39423.1 R39424.1 R39425.1 R39426.1 R39427.1 R39428.1 R39429.1 R39430.1 R39431.1 R39432.1 R39433.1 R39434.1 R39435.1 R39436.1 R39437.1 R39438.1 R39439.1 R39440.1 R39441.1 R39442.1 R39443.1 R39444.1 R39445.1 R39446.1 R39447.1 R39448.1 R39449.1 R39450.1 R39451.1 R39452.1 R39453.1 R39454.1 R39455.1 R39456.1 R39457.1 R39458.1 R39459.1 R39460.1 R39461.1 R39462.1 R39463.1 R39464.1 R39465.1 R39466.1 R39467.1 R39468.1 R39469.1 R39470.1 R39471.1 R39472.1 R39473.1 R39474.1 R39475.1 R39476.1 R39477.1 R39478.1 R39479.1 R39480.1 R39481.1 R39482.1 R39483.1 R39484.1 R39485.1 R39486.1 R39487.1 R39488.1 R39489.1 R39490.1 R39491.1 R39492.1 R39493.1 R39494.1 R39495.1 R39496.1 R39497.1 R39498.1 R39499.1 R39500.1 R39501.1 R39502.1 R39503.1 R39504.1 R39505.1 R39506.1 R39507.1 R39508.1 R39509.1 R39510.1 R39511.1 R39512.1 R39513.1 R39514.1 R39515.1 R39516.1 R39517.1 R39518.1 R39519.1 R39520.1 R39521.1 R39522.1 R39523.1 R39524.1 R39525.1 R39526.1 R39527.1 R39528.1 R39529.1 R39530.1 R39531.1 R39532.1 R39533.1 R39534.1 R39535.1 R39536.1 R39537.1 R39538.1 R39539.1 R39540.1 R39541.1 R39542.1 R39543.1 R39544.1 R39545.1 R39546.1 R39547.1 R39548.1 R39549.1 R39550.1 R39551.1 R39552.1 R39553.1 R39554.1 R39555.1 R39556.1 R39557.1 R39558.1 R39559.1 R39560.1 R39561.1 R39562.1 R39563.1 R39564.1 R39565.1 R39566.1 R39567.1 R39568.1 R39569.1 R39570.1 R39571.1 R39572.1 R39573.1 R39574.1 R39575.1 R39576.1 R39577.1 R39578.1 R39579.1 R39580.1 R39581.1 R39582.1 R39583.1 R39584.1 R39585.1 R39586.1 R39587.1 R39588.1 R39589.1 R39590.1 R39591.1 R39592.1 R39593.1 R39594.1 R39595.1 R39596.1 R39597.1 R39598.1 R39599.1 R39600.1
N$207: R39401.2 R39402.2 R39403.2 R39404.2 R39405.2 R39406.2 R39407.2 R39408.2 R39409.2 R39410.2 R39411.2 R39412.2 R39413.2 R39414.2 R39415.2 R39416.2 R39417.2 R39418.2 R39419.2 R39420.2 R39421.2 R39422.2 R39423.2 R39424.2 R39425.2 R39426.2 R39427.2 R39428.2 R39429.2 R39430.2 R39431.2 R39432.2 R39433.2 R39434.2 R39435.2 R39436.2 R39437.2 R39438.2 R39439.2 R39440.2 R39441.2 R39442.2 R39443.2 R39444.2 R39445.2 R39446.2 R39447.2 R39448.2 R39449.2 R39450.2 R39451.2 R39452.2 R39453.2 R39454.2 R39455.2 R39456.2 R39457.2 R39458.2 R39459.2 R39460.2 R39461.2 R39462.2 R39463.2 R39464.2 R39465.2 R39466.2 R39467.2 R39468.2 R39469.2 R39470.2 R39471.2 R39472.2 R39473.2 R39474.2 R39475.2 R39476.2 R39477.2 R39478.2 R39479.2 R39480.2 R39481.2 R39482.2 R39483.2 R39484.2 R39485.2 R39486.2 R39487.2 R39488.2 R39489.2 R39490.2 R39491.2 R39492.2 R39493.2 R39494.2 R39495.2 R39496.2 R39497.2 R39498.2 R39499.2 R39500.2 R39501.2 R39502.2 R39503.2 R39504.2 R39505.2 R39506.2 R39507.2 R39508.2 R39509.2 R39510.2 R39511.2 R39512.2 R39513.2 R39514.2 R39515.2 R39516.2 R39517.2 R39518.2 R39519.2 R39520.2 R39521.2 R39522.2 R39523.2 R39524.2 R39525.2 R39526.2 R39527.2 R39528.2 R39529.2 R39530.2 R39531.2 R39532.2 R39533.2 R39534.2 R39535.2 R39536.2 R39537.2 R39538.2 R39539.2 R39540.2 R39541.2 R39542.2 R39543.2 R39544.2 R39545.2 R39546.2 R39547.2 R39548.2 R39549.2 R39550.2 R39551.2 R39552.2 R39553.2 R39554.2 R39555.2 R39556.2 R39557.2 R39558.2 R39559.2 R39560.2 R39561.2 R39562.2 R39563.2 R39564.2 R39565.2 R39566.2 R39567.2 R39568.2 R39569.2 R39570.2 R39571.2 R39572.2 R39573.2 R39574.2 R39575.2 R39576.2 R39577.2 R39578.2 R39579.2 R39580.2 R39581.2 R39582.2 R39583.2 R39584.2 R39585.2 R39586.2 R39587.2 R39588.2 R39589.2 R39590.2 R39591.2 R39592.2 R39593.2 R39594.2 R39595.2 R39596.2 R39597.2 R39598.2 R39599.2 R39600.2 R39601.1 R39602.1 R39603.1 R39604.1 R39605.1 R39606.1 R39607.1 R39608.1 R39609.1 R39610.1 R39611.1 R39612.1 R39613.1 R39614.1 R39615.1 R39616.1 R39617.1 R39618.1 R39619.1 R39620.1 R39621.1 R39622.1 R39623.1 R39624.1 R39625.1 R39626.1 R39627.1 R39628.1 R39629.1 R39630.1 R39631.1 R39632.1 R39633.1 R39634.1 R39635.1 R39636.1 R39637.1 R39638.1 R39639.1 R39640.1 R39641.1 R39642.1 R39643.1 R39644.1 R39645.1 R39646.1 R39647.1 R39648.1 R39649.1 R39650.1 R39651.1 R39652.1 R39653.1 R39654.1 R39655.1 R39656.1 R39657.1 R39658.1 R39659.1 R39660.1 R39661.1 R39662.1 R39663.1 R39664.1 R39665.1 R39666.1 R39667.1 R39668.1 R39669.1 R39670.1 R39671.1 R39672.1 R39673.1 R39674.1 R39675.1 R39676.1 R39677.1 R39678.1 R39679.1 R39680.1 R39681.1 R39682.1 R39683.1 R39684.1 R39685.1 R39686.1 R39687.1 R39688.1 R39689.1 R39690.1 R39691.1 R39692.1 R39693.1 R39694.1 R39695.1 R39696.1 R39697.1 R39698.1 R39699.1 R39700.1 R39701.1 R39702.1 R39703.1 R39704.1 R39705.1 R39706.1 R39707.1 R39708.1 R39709.1 R39710.1 R39711.1 R39712.1 R39713.1 R39714.1 R39715.1 R39716.1 R39717.1 R39718.1 R39719.1 R39720.1 R39721.1 R39722.1 R39723.1 R39724.1 R39725.1 R39726.1 R39727.1 R39728.1 R39729.1 R39730.1 R39731.1 R39732.1 R39733.1 R39734.1 R39735.1 R39736.1 R39737.1 R39738.1 R39739.1 R39740.1 R39741.1 R39742.1 R39743.1 R39744.1 R39745.1 R39746.1 R39747.1 R39748.1 R39749.1 R39750.1 R39751.1 R39752.1 R39753.1 R39754.1 R39755.1 R39756.1 R39757.1 R39758.1 R39759.1 R39760.1 R39761.1 R39762.1 R39763.1 R39764.1 R39765.1 R39766.1 R39767.1 R39768.1 R39769.1 R39770.1 R39771.1 R39772.1 R39773.1 R39774.1 R39775.1 R39776.1 R39777.1 R39778.1 R39779.1 R39780.1 R39781.1 R39782.1 R39783.1 R39784.1 R39785.1 R39786.1 R39787.1 R39788.1 R39789.1 R39790.1 R39791.1 R39792.1 R39793.1 R39794.1 R39795.1 R39796.1 R39797.1 R39798.1 R39799.1 R39800.1
N$208: R39601.2 R39602.2 R39603.2 R39604.2 R39605.2 R39606.2 R39607.2 R39608.2 R39609.2 R39610.2 R39611.2 R39612.2 R39613.2 R39614.2 R39615.2 R39616.2 R39617.2 R39618.2 R39619.2 R39620.2 R39621.2 R39622.2 R39623.2 R39624.2 R39625.2 R39626.2 R39627.2 R39628.2 R39629.2 R39630.2 R39631.2 R39632.2 R39633.2 R39634.2 R39635.2 R39636.2 R39637.2 R39638.2 R39639.2 R39640.2 R39641.2 R39642.2 R39643.2 R39644.2 R39645.2 R39646.2 R39647.2 R39648.2 R39649.2 R39650.2 R39651.2 R39652.2 R39653.2 R39654.2 R39655.2 R39656.2 R39657.2 R39658.2 R39659.2 R39660.2 R39661.2 R39662.2 R39663.2 R39664.2 R39665.2 R39666.2 R39667.2 R39668.2 R39669.2 R39670.2 R39671.2 R39672.2 R39673.2 R39674.2 R39675.2 R39676.2 R39677.2 R39678.2 R39679.2 R39680.2 R39681.2 R39682.2 R39683.2 R39684.2 R39685.2 R39686.2 R39687.2 R39688.2 R39689.2 R39690.2 R39691.2 R39692.2 R39693.2 R39694.2 R39695.2 R39696.2 R39697.2 R39698.2 R39699.2 R39700.2 R39701.2 R39702.2 R39703.2 R39704.2 R39705.2 R39706.2 R39707.2 R39708.2 R39709.2 R39710.2 R39711.2 R39712.2 R39713.2 R39714.2 R39715.2 R39716.2 R39717.2 R39718.2 R39719.2 R39720.2 R39721.2 R39722.2 R39723.2 R39724.2 R39725.2 R39726.2 R39727.2 R39728.2 R39729.2 R39730.2 R39731.2 R39732.2 R39733.2 R39734.2 R39735.2 R39736.2 R39737.2 R39738.2 R39739.2 R39740.2 R39741.2 R39742.2 R39743.2 R39744.2 R39745.2 R39746.2 R39747.2 R39748.2 R39749.2 R39750.2 R39751.2 R39752.2 R39753.2 R39754.2 R39755.2 R39756.2 R39757.2 R39758.2 R39759.2 R39760.2 R39761.2 R39762.2 R39763.2 R39764.2 R39765.2 R39766.2 R39767.2 R39768.2 R39769.2 R39770.2 R39771.2 R39772.2 R39773.2 R39774.2 R39775.2 R39776.2 R39777.2 R39778.2 R39779.2 R39780.2 R39781.2 R39782.2 R39783.2 R39784.2 R39785.2 R39786.2 R39787.2 R39788.2 R39789.2 R39790.2 R39791.2 R39792.2 R39793.2 R39794.2 R39795.2 R39796.2 R39797.2 R39798.2 R39799.2 R39800.2 R39801.1 R39802.1 R39803.1 R39804.1 R39805.1 R39806.1 R39807.1 R39808.1 R39809.1 R39810.1 R39811.1 R39812.1 R39813.1 R39814.1 R39815.1 R39816.1 R39817.1 R39818.1 R39819.1 R39820.1 R39821.1 R39822.1 R39823.1 R39824.1 R39825.1 R39826.1 R39827.1 R39828.1 R39829.1 R39830.1 R39831.1 R39832.1 R39833.1 R39834.1 R39835.1 R39836.1 R39837.1 R39838.1 R39839.1 R39840.1 R39841.1 R39842.1 R39843.1 R39844.1 R39845.1 R39846.1 R39847.1 R39848.1 R39849.1 R39850.1 R39851.1 R39852.1 R39853.1 R39854.1 R39855.1 R39856.1 R39857.1 R39858.1 R39859.1 R39860.1 R39861.1 R39862.1 R39863.1 R39864.1 R39865.1 R39866.1 R39867.1 R39868.1 R39869.1 R39870.1 R39871.1 R39872.1 R39873.1 R39874.1 R39875.1 R39876.1 R39877.1 R39878.1 R39879.1 R39880.1 R39881.1 R39882.1 R39883.1 R39884.1 R39885.1 R39886.1 R39887.1 R39888.1 R39889.1 R39890.1 R39891.1 R39892.1 R39893.1 R39894.1 R39895.1 R39896.1 R39897.1 R39898.1 R39899.1 R39900.1 R39901.1 R39902.1 R39903.1 R39904.1 R39905.1 R39906.1 R39907.1 R39908.1 R39909.1 R39910.1 R39911.1 R39912.1 R39913.1 R39914.1 R39915.1 R39916.1 R39917.1 R39918.1 R39919.1 R39920.1 R39921.1 R39922.1 R39923.1 R39924.1 R39925.1 R39926.1 R39927.1 R39928.1 R39929.1 R39930.1 R39931.1 R39932.1 R39933.1 R39934.1 R39935.1 R39936.1 R39937.1 R39938.1 R39939.1 R39940.1 R39941.1 R39942.1 R39943.1 R39944.1 R39945.1 R39946.1 R39947.1 R39948.1 R39949.1 R39950.1 R39951.1 R39952.1 R39953.1 R39954.1 R39955.1 R39956.1 R39957.1 R39958.1 R39959.1 R39960.1 R39961.1 R39962.1 R39963.1 R39964.1 R39965.1 R39966.1 R39967.1 R39968.1 R39969.1 R39970.1 R39971.1 R39972.1 R39973.1 R39974.1 R39975.1 R39976.1 R39977.1 R39978.1 R39979.1 R39980.1 R39981.1 R39982.1 R39983.1 R39984.1 R39985.1 R39986.1 R39987.1 R39988.1 R39989.1 R39990.1 R39991.1 R39992.1 R39993.1 R39994.1 R39995.1 R39996.1 R39997.1 R39998.1 R39999.1 R40000.1
N$209: R39801.2 R39802.2 R39803.2 R39804.2 R39805.2 R39806.2 R39807.2 R39808.2 R39809.2 R39810.2 R39811.2 R39812.2 R39813.2 R39814.2 R39815.2 R39816.2 R39817.2 R39818.2 R39819.2 R39820.2 R39821.2 R39822.2 R39823.2 R39824.2 R39825.2 R39826.2 R39827.2 R39828.2 R39829.2 R39830.2 R39831.2 R39832.2 R39833.2 R39834.2 R39835.2 R39836.2 R39837.2 R39838.2 R39839.2 R39840.2 R39841.2 R39842.2 R39843.2 R39844.2 R39845.2 R39846.2 R39847.2 R39848.2 R39849.2 R39850.2 R39851.2 R39852.2 R39853.2 R39854.2 R39855.2 R39856.2 R39857.2 R39858.2 R39859.2 R39860.2 R39861.2 R39862.2 R39863.2 R39864.2 R39865.2 R39866.2 R39867.2 R39868.2 R39869.2 R39870.2 R39871.2 R39872.2 R39873.2 R39874.2 R39875.2 R39876.2 R39877.2 R39878.2 R39879.2 R39880.2 R39881.2 R39882.2 R39883.2 R39884.2 R39885.2 R39886.2 R39887.2 R39888.2 R39889.2 R39890.2 R39891.2 R39892.2 R39893.2 R39894.2 R39895.2 R39896.2 R39897.2 R39898.2 R39899.2 R39900.2 R39901.2 R39902.2 R39903.2 R39904.2 R39905.2 R39906.2 R39907.2 R39908.2 R39909.2 R39910.2 R39911.2 R39912.2 R39913.2 R39914.2 R39915.2 R39916.2 R39917.2 R39918.2 R39919.2 R39920.2 R39921.2 R39922.2 R39923.2 R39924.2 R39925.2 R39926.2 R39927.2 R39928.2 R39929.2 R39930.2 R39931.2 R39932.2 R39933.2 R39934.2 R39935.2 R39936.2 R39937.2 R39938.2 R39939.2 R39940.2 R39941.2 R39942.2 R39943.2 R39944.2 R39945.2 R39946.2 R39947.2 R39948.2 R39949.2 R39950.2 R39951.2 R39952.2 R39953.2 R39954.2 R39955.2 R39956.2 R39957.2 R39958.2 R39959.2 R39960.2 R39961.2 R39962.2 R39963.2 R39964.2 R39965.2 R39966.2 R39967.2 R39968.2 R39969.2 R39970.2 R39971.2 R39972.2 R39973.2 R39974.2 R39975.2 R39976.2 R39977.2 R39978.2 R39979.2 R39980.2 R39981.2 R39982.2 R39983.2 R39984.2 R39985.2 R39986.2 R39987.2 R39988.2 R39989.2 R39990.2 R39991.2 R39992.2 R39993.2 R39994.2 R39995.2 R39996.2 R39997.2 R39998.2 R39999.2 R40000.2

## Library data of the parts
FID1 = MF_Aesthetics:FIDUCIAL: Library: MF_Aesthetics Description: Fiducial marking for PCB alignment inside PNP and other machines.; HOUSEPART: NO; MPN: ERJ-1GNF1002C; POPULATE: 0
FID2 = MF_Aesthetics:FIDUCIAL: Library: MF_Aesthetics Description: Fiducial marking for PCB alignment inside PNP and other machines.; HOUSEPART: NO; MPN: CRCW020110K0FNED; POPULATE: 0
FID3 = MF_Aesthetics:FIDUCIAL: Library: MF_Aesthetics Description: Fiducial marking for PCB alignment inside PNP and other machines.; HOUSEPART: NO; MPN: AC0201FR-0710KL; POPULATE: 0
R1-R40000 = PP_Passives:RESISTOR: Resistors